# Altium schematic sheet SDCard.SchDoc: Apalis Evaluation Board 1.1
size A3; Organization: Toradex AG; Address1: Altsagenstrasse 5; Address2: Horw; Address3: 6048; Address4: Switzerland; DocumentNumber: 8; Revision: V1.1; SheetNumber: 8; SheetTotal: 32; PageSetup: Record=PageOptions|CenterHorizontal=True|CenterVertical=True|PrintScale=0.73|XCorrection=1.00|YCorrection=1.00|PrintKind=0|BorderSize=5000000|LeftOffset=0|BottomOffset=0|Orientation=2|PaperLength=1000|PaperWidth=1000|Scale=100|PaperSource=7|PrintQuality=-4|MediaType=1|DitherType=10|PaperKind=A4|PrintScaleMode=1
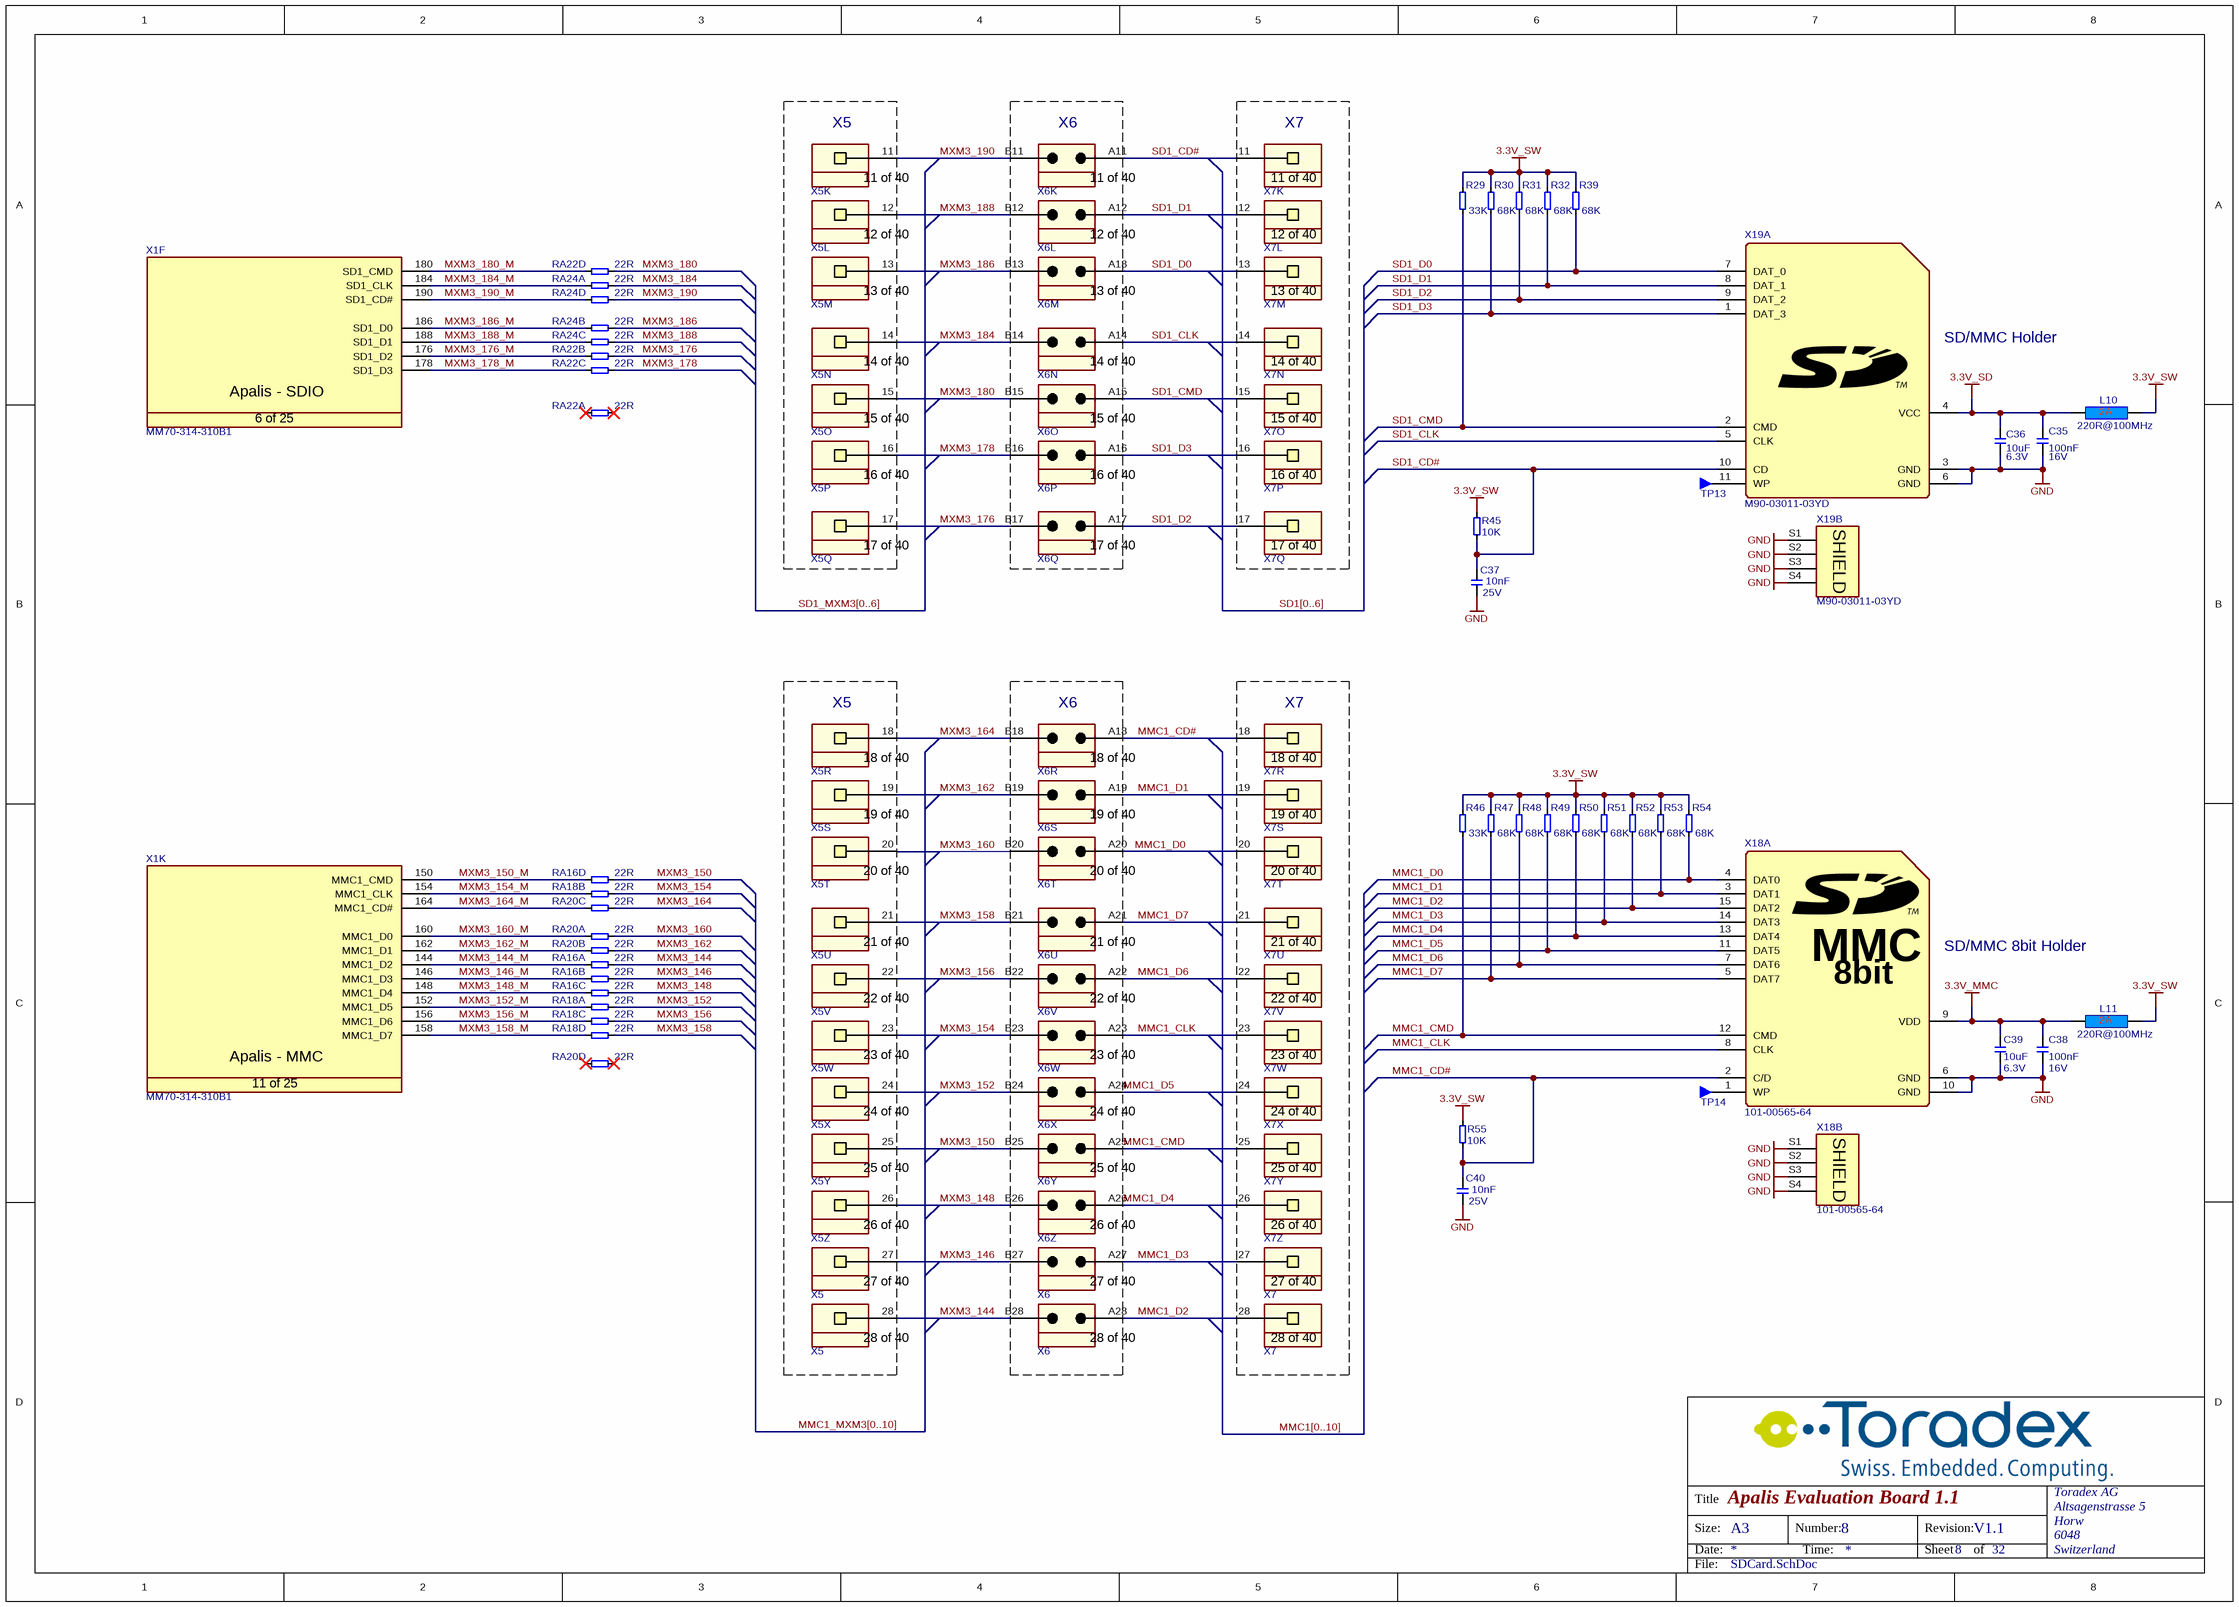
[diagram p0: SDCard.SchDoc]

## Parts
C35  Rating: 16V  [T_CAPC0603X33N]  (hidden comment: 100nF)
C36  Rating: 6.3V  [T_CAPC0603X33N]  (hidden comment: 10uF)
C37  Rating: 25V  [T_CAPC0603X33N]  (hidden comment: 10nF)
C38  Rating: 16V  [T_CAPC0603X33N]  (hidden comment: 100nF)
C39  Rating: 6.3V  [T_CAPC0603X33N]  (hidden comment: 10uF)
C40  Rating: 25V  [T_CAPC0603X33N]  (hidden comment: 10nF)
L10  220R@100MHz  [INDC1608X95N]
L11  220R@100MHz  [INDC1608X95N]
R29  33K  [T_RESC0603X30N]
R30  68K  [T_RESC0603X30N]
R31  68K  [T_RESC0603X30N]
R32  68K  [T_RESC0603X30N]
R39  68K  [T_RESC0603X30N]
R45  10K  [T_RESC0603X30N]
R46  33K  [T_RESC0603X30N]
R47  68K  [T_RESC0603X30N]
R48  68K  [T_RESC0603X30N]
R49  68K  [T_RESC0603X30N]
R50  68K  [T_RESC0603X30N]
R51  68K  [T_RESC0603X30N]
R52  68K  [T_RESC0603X30N]
R53  68K  [T_RESC0603X30N]
R54  68K  [T_RESC0603X30N]
R55  10K  [T_RESC0603X30N]
RA16  22R  [T_Resistor_Array_X4]  (parts A,B,C,D of 4)
RA18  22R  [T_Resistor_Array_X4]  (parts A,B,C,D of 4)
RA20  22R  [T_Resistor_Array_X4]  (parts A,B,C,D of 4)
RA22  22R  [T_Resistor_Array_X4]  (parts A,B,C,D of 4)
RA24  22R  [T_Resistor_Array_X4]  (parts A,B,C,D of 4)
TP13  Testpin  [T_TP-THT]  (value not drawn)
TP14  Testpin  [T_TP-THT]  (value not drawn)
X1  Manufacturer Part No.: MM70-314-310B1  [T_JAE_MM70-314-310B1]  (hidden comment: CON-JAE-MM70-314-310B1-314-0.5mm)  (parts F,K of 25)
X5  SSW-110-01-G-S  [T_Samtec_SSW-110-01-G-S]  (value not drawn)  (parts K,L,M,N,O,P,Q,R,S,T,U,V,W,X,Y,Z,27,28 of 40)
X6  TSW-110-07-G-D  [T_Samtec_TSW-110-07-G-D]  (value not drawn)  (parts K,L,M,N,O,P,Q,R,S,T,U,V,W,X,Y,Z,27,28 of 40)
X7  SSW-110-01-G-S  [T_Samtec_SSW-110-01-G-S]  (value not drawn)  (parts K,L,M,N,O,P,Q,R,S,T,U,V,W,X,Y,Z,27,28 of 40)
X18  101-00565-64  [T_ AMPHENOL_101-00565]  (parts A,B of 2)
X19  M90-03011-03YD  [T_ AMPHENOL_101-00708-64]  (parts A,B of 2)

## Blocks framed on the sheet
X5: X5
X6: X6
X7: X7
X5: X5
X6: X6
X7: X7

## Nets
3.3V_MMC: C38.2 C39.2 L11.1 X18.9(VDD)
3.3V_SD: C35.2 C36.2 L10.1 X19.4(VCC)
3.3V_SW: L10.2 L11.2 R29.2 R30.2 R31.2 R32.2 R39.2 R45.2 R46.2 R47.2 R48.2 R49.2 R50.2 R51.2 R52.2 R53.2 R54.2 R55.2
GND: C35.1 C36.1 C37.1 C38.1 C39.1 C40.1 X18.6(GND) X18.10(GND) X18.S1(S) X18.S2(S) X18.S3(S) X18.S4(S) X19.3(GND) X19.6(GND) X19.S1(S) X19.S2(S) X19.S3(S) X19.S4(S)
MMC1_CD#: C40.2 R55.1 X6.A18 X7.18 X18.2(C/D)
MMC1_CLK: X6.A23 X7.23 X18.8(CLK)
MMC1_CMD: R46.1 X6.A25 X7.25 X18.12(CMD)
MMC1_D0: R54.1 X6.A20 X7.20 X18.4(DAT0)
MMC1_D1: R53.1 X6.A19 X7.19 X18.3(DAT1)
MMC1_D2: R52.1 X6.A28 X7.28 X18.15(DAT2)
MMC1_D3: R51.1 X6.A27 X7.27 X18.14(DAT3)
MMC1_D4: R50.1 X6.A26 X7.26 X18.13(DAT4)
MMC1_D5: R49.1 X6.A24 X7.24 X18.11(DAT5)
MMC1_D6: R48.1 X6.A22 X7.22 X18.7(DAT6)
MMC1_D7: R47.1 X6.A21 X7.21 X18.5(DAT7)
MXM3_144: RA16.5 X5.28 X6.B28
MXM3_144_M: RA16.1 X1.144(MMC1_D2)
MXM3_146: RA16.6 X5.27 X6.B27
MXM3_146_M: RA16.2 X1.146(MMC1_D3)
MXM3_148: RA16.7 X5.26 X6.B26
MXM3_148_M: RA16.3 X1.148(MMC1_D4)
MXM3_150: RA16.8 X5.25 X6.B25
MXM3_150_M: RA16.4 X1.150(MMC1_CMD)
MXM3_152: RA18.5 X5.24 X6.B24
MXM3_152_M: RA18.1 X1.152(MMC1_D5)
MXM3_154: RA18.6 X5.23 X6.B23
MXM3_154_M: RA18.2 X1.154(MMC1_CLK)
MXM3_156: RA18.7 X5.22 X6.B22
MXM3_156_M: RA18.3 X1.156(MMC1_D6)
MXM3_158: RA18.8 X5.21 X6.B21
MXM3_158_M: RA18.4 X1.158(MMC1_D7)
MXM3_160: RA20.5 X5.20 X6.B20
MXM3_160_M: RA20.1 X1.160(MMC1_D0)
MXM3_162: RA20.6 X5.19 X6.B19
MXM3_162_M: RA20.2 X1.162(MMC1_D1)
MXM3_164: RA20.7 X5.18 X6.B18
MXM3_164_M: RA20.3 X1.164(MMC1_CD#)
MXM3_176: RA22.6 X5.17 X6.B17
MXM3_176_M: RA22.2 X1.176(SD1_D2)
MXM3_178: RA22.7 X5.16 X6.B16
MXM3_178_M: RA22.3 X1.178(SD1_D3)
MXM3_180: RA22.8 X5.15 X6.B15
MXM3_180_M: RA22.4 X1.180(SD1_CMD)
MXM3_184: RA24.5 X5.14 X6.B14
MXM3_184_M: RA24.1 X1.184(SD1_CLK)
MXM3_186: RA24.6 X5.13 X6.B13
MXM3_186_M: RA24.2 X1.186(SD1_D0)
MXM3_188: RA24.7 X5.12 X6.B12
MXM3_188_M: RA24.3 X1.188(SD1_D1)
MXM3_190: RA24.8 X5.11 X6.B11
MXM3_190_M: RA24.4 X1.190(SD1_CD#)
SD1_CD#: C37.2 R45.1 X6.A11 X7.11 X19.10(CD)
SD1_CLK: X6.A14 X7.14 X19.5(CLK)
SD1_CMD: R29.1 X6.A15 X7.15 X19.2(CMD)
SD1_D0: R39.1 X6.A13 X7.13 X19.7(DAT_0)
SD1_D1: R32.1 X6.A12 X7.12 X19.8(DAT_1)
SD1_D2: R31.1 X6.A17 X7.17 X19.9(DAT_2)
SD1_D3: R30.1 X6.A16 X7.16 X19.1(DAT_3)
NetTP13_1: TP13.1 X19.11(WP)
NetTP14_1: TP14.1 X18.1(WP)

Not connected (* = marked no-connect by the designer): RA20 4* 8*; RA22 1* 5*

## Buses and harness runs
bus MMC1[0..10]
bus MMC1_MXM3[0..10]
bus SD1[0..6]
bus SD1_MXM3[0..6]

## Notes on the sheet
- (near X19) SD/MMC Holder
- (near X18) SD/MMC 8bit Holder
- Title
- Size:
- Date:
- A3
- Number:
- Time:
- Revision:
- Sheet
- of
- File:
- (in symbol CON-Amphenol-101-00565-64, part A) MMC; 8bit
- (in symbol CON-Amphenol-101-00565-64, part B) SHIELD
- (in symbol CON-Cenlink-M90-03011-03YD, part B) SHIELD
- (in symbol CON-JAE-MM70-314-310B1-314-0.5mm, part F) Apalis - SDIO; 6 of 25
- (in symbol CON-JAE-MM70-314-310B1-314-0.5mm, part K) Apalis - MMC; 11 of 25
- (in symbol CON-Samtec-SSW-110-01-G-S, part K) 11 of 40
- (in symbol CON-Samtec-SSW-110-01-G-S, part L) 12 of 40
- (in symbol CON-Samtec-SSW-110-01-G-S, part M) 13 of 40
- (in symbol CON-Samtec-SSW-110-01-G-S, part N) 14 of 40
- (in symbol CON-Samtec-SSW-110-01-G-S, part O) 15 of 40
- (in symbol CON-Samtec-SSW-110-01-G-S, part P) 16 of 40
- (in symbol CON-Samtec-SSW-110-01-G-S, part Q) 17 of 40
- (in symbol CON-Samtec-SSW-110-01-G-S, part R) 18 of 40
- (in symbol CON-Samtec-SSW-110-01-G-S, part S) 19 of 40
- (in symbol CON-Samtec-SSW-110-01-G-S, part T) 20 of 40
- (in symbol CON-Samtec-SSW-110-01-G-S, part U) 21 of 40
- (in symbol CON-Samtec-SSW-110-01-G-S, part V) 22 of 40
- (in symbol CON-Samtec-SSW-110-01-G-S, part W) 23 of 40
- (in symbol CON-Samtec-SSW-110-01-G-S, part X) 24 of 40
- (in symbol CON-Samtec-SSW-110-01-G-S, part Y) 25 of 40
- (in symbol CON-Samtec-SSW-110-01-G-S, part Z) 26 of 40
- (in symbol CON-Samtec-SSW-110-01-G-S, part 27) 27 of 40
- (in symbol CON-Samtec-SSW-110-01-G-S, part 28) 28 of 40
- (in symbol CON-Samtec-TSW-110-07-G-D, part K) 11 of 40
- (in symbol CON-Samtec-TSW-110-07-G-D, part L) 12 of 40
- (in symbol CON-Samtec-TSW-110-07-G-D, part M) 13 of 40
- (in symbol CON-Samtec-TSW-110-07-G-D, part N) 14 of 40
- (in symbol CON-Samtec-TSW-110-07-G-D, part O) 15 of 40
- (in symbol CON-Samtec-TSW-110-07-G-D, part P) 16 of 40
- (in symbol CON-Samtec-TSW-110-07-G-D, part Q) 17 of 40
- (in symbol CON-Samtec-TSW-110-07-G-D, part R) 18 of 40
- (in symbol CON-Samtec-TSW-110-07-G-D, part S) 19 of 40
- (in symbol CON-Samtec-TSW-110-07-G-D, part T) 20 of 40
- (in symbol CON-Samtec-TSW-110-07-G-D, part U) 21 of 40
- (in symbol CON-Samtec-TSW-110-07-G-D, part V) 22 of 40
- (in symbol CON-Samtec-TSW-110-07-G-D, part W) 23 of 40
- (in symbol CON-Samtec-TSW-110-07-G-D, part X) 24 of 40
- (in symbol CON-Samtec-TSW-110-07-G-D, part Y) 25 of 40
- (in symbol CON-Samtec-TSW-110-07-G-D, part Z) 26 of 40
- (in symbol CON-Samtec-TSW-110-07-G-D, part 27) 27 of 40
- (in symbol CON-Samtec-TSW-110-07-G-D, part 28) 28 of 40

## Library data of the parts
C35 C38 = C-X7R-100nF-16V-10%-0603: Capacitor Ceramic X7R 100nF 16V 10% 0603; Tolerance: 10%; Type: X7R; Value: 100nF
C36 C39 = C-X5R-10uF-6.3V-20%-0603: Capacitor Ceramic X5R 10uF 6.3V 20% 0603; Tolerance: 20%; Type: X5R; Value: 10uF
C37 C40 = C-X7R-10nF-25V-10%-0603: Capacitor Ceramic X7R 10nF 25V 10% 0603; Tolerance: 10%; Type: X7R; Value: 10nF
L10 L11 = L-220R@100MHz-2A-25%-0603: 220R@100MHz 2A EMI FILTER; Tolerance: 25%; Rating: 2A; Value: 220R@100MHz
R29 R46 = R-33KR-63mW-5%-0603: Resistor 33 Kohm 63mW 5% 0603; Value: 33KR; Rating: 63mW; Tolerance: 5%
R30-R32 R39 R47-R54 = R-68KR-63mW-5%-0603: Resistor 68 Kohm 63mW 5% 0603; Value: 68KR; Rating: 63mW; Tolerance: 5%
R45 R55 = R-10KR-63mW-5%-0603: Resistor 10 Kohm 63mW 5% 0603; Value: 10KR; Rating: 63mW; Tolerance: 5%
RA16 RA18 RA20 RA22 RA24 = RA-22R-63mW-5%-1206-div: Resistor Array 22 R 63mW 5% 1206; Tolerance: 5%; Power Dissipation: 63mW; Value: 22R
TP13 TP14 = Testpin: Testpin TH
X1 = CON-JAE-MM70-314-310B1-314-0.5mm: MXM3 Connector; Manufacturer Name: JAE; No. of ways: 314
X5 X7 = CON-Samtec-SSW-110-01-G-S: Receptacle Female Socket 1x40 pin 2.54mm pitch; Manufacturer Name: Samtec; Pitch: 2.54mm; No. of ways: 1x40; Manufacturer Part No.: SSW-110-01-G-S
X6 = CON-Samtec-TSW-110-07-G-D: Header 2x40 pin 2.54mm pitch; Manufacturer Name: Samtec; Pitch: 2.54mm; No. of ways: 2x40; Manufacturer Part No.: TSW-110-07-G-D
X18 = CON-Amphenol-101-00565-64: SD/MMC 8bit Card Holder; No. of ways: 13+2; Manufacturer Name: Amphenol; Manufacturer Part No.: 101-00565-64
X19 = CON-Cenlink-M90-03011-03YD: SD/MMC Card Holder; No. of ways: 9+2; Manufacturer Name: Cenlink; Manufacturer Part No.: M90-03011-03YD